# EasyEDA Pro project Access Control Core.eprj, board Card Reader
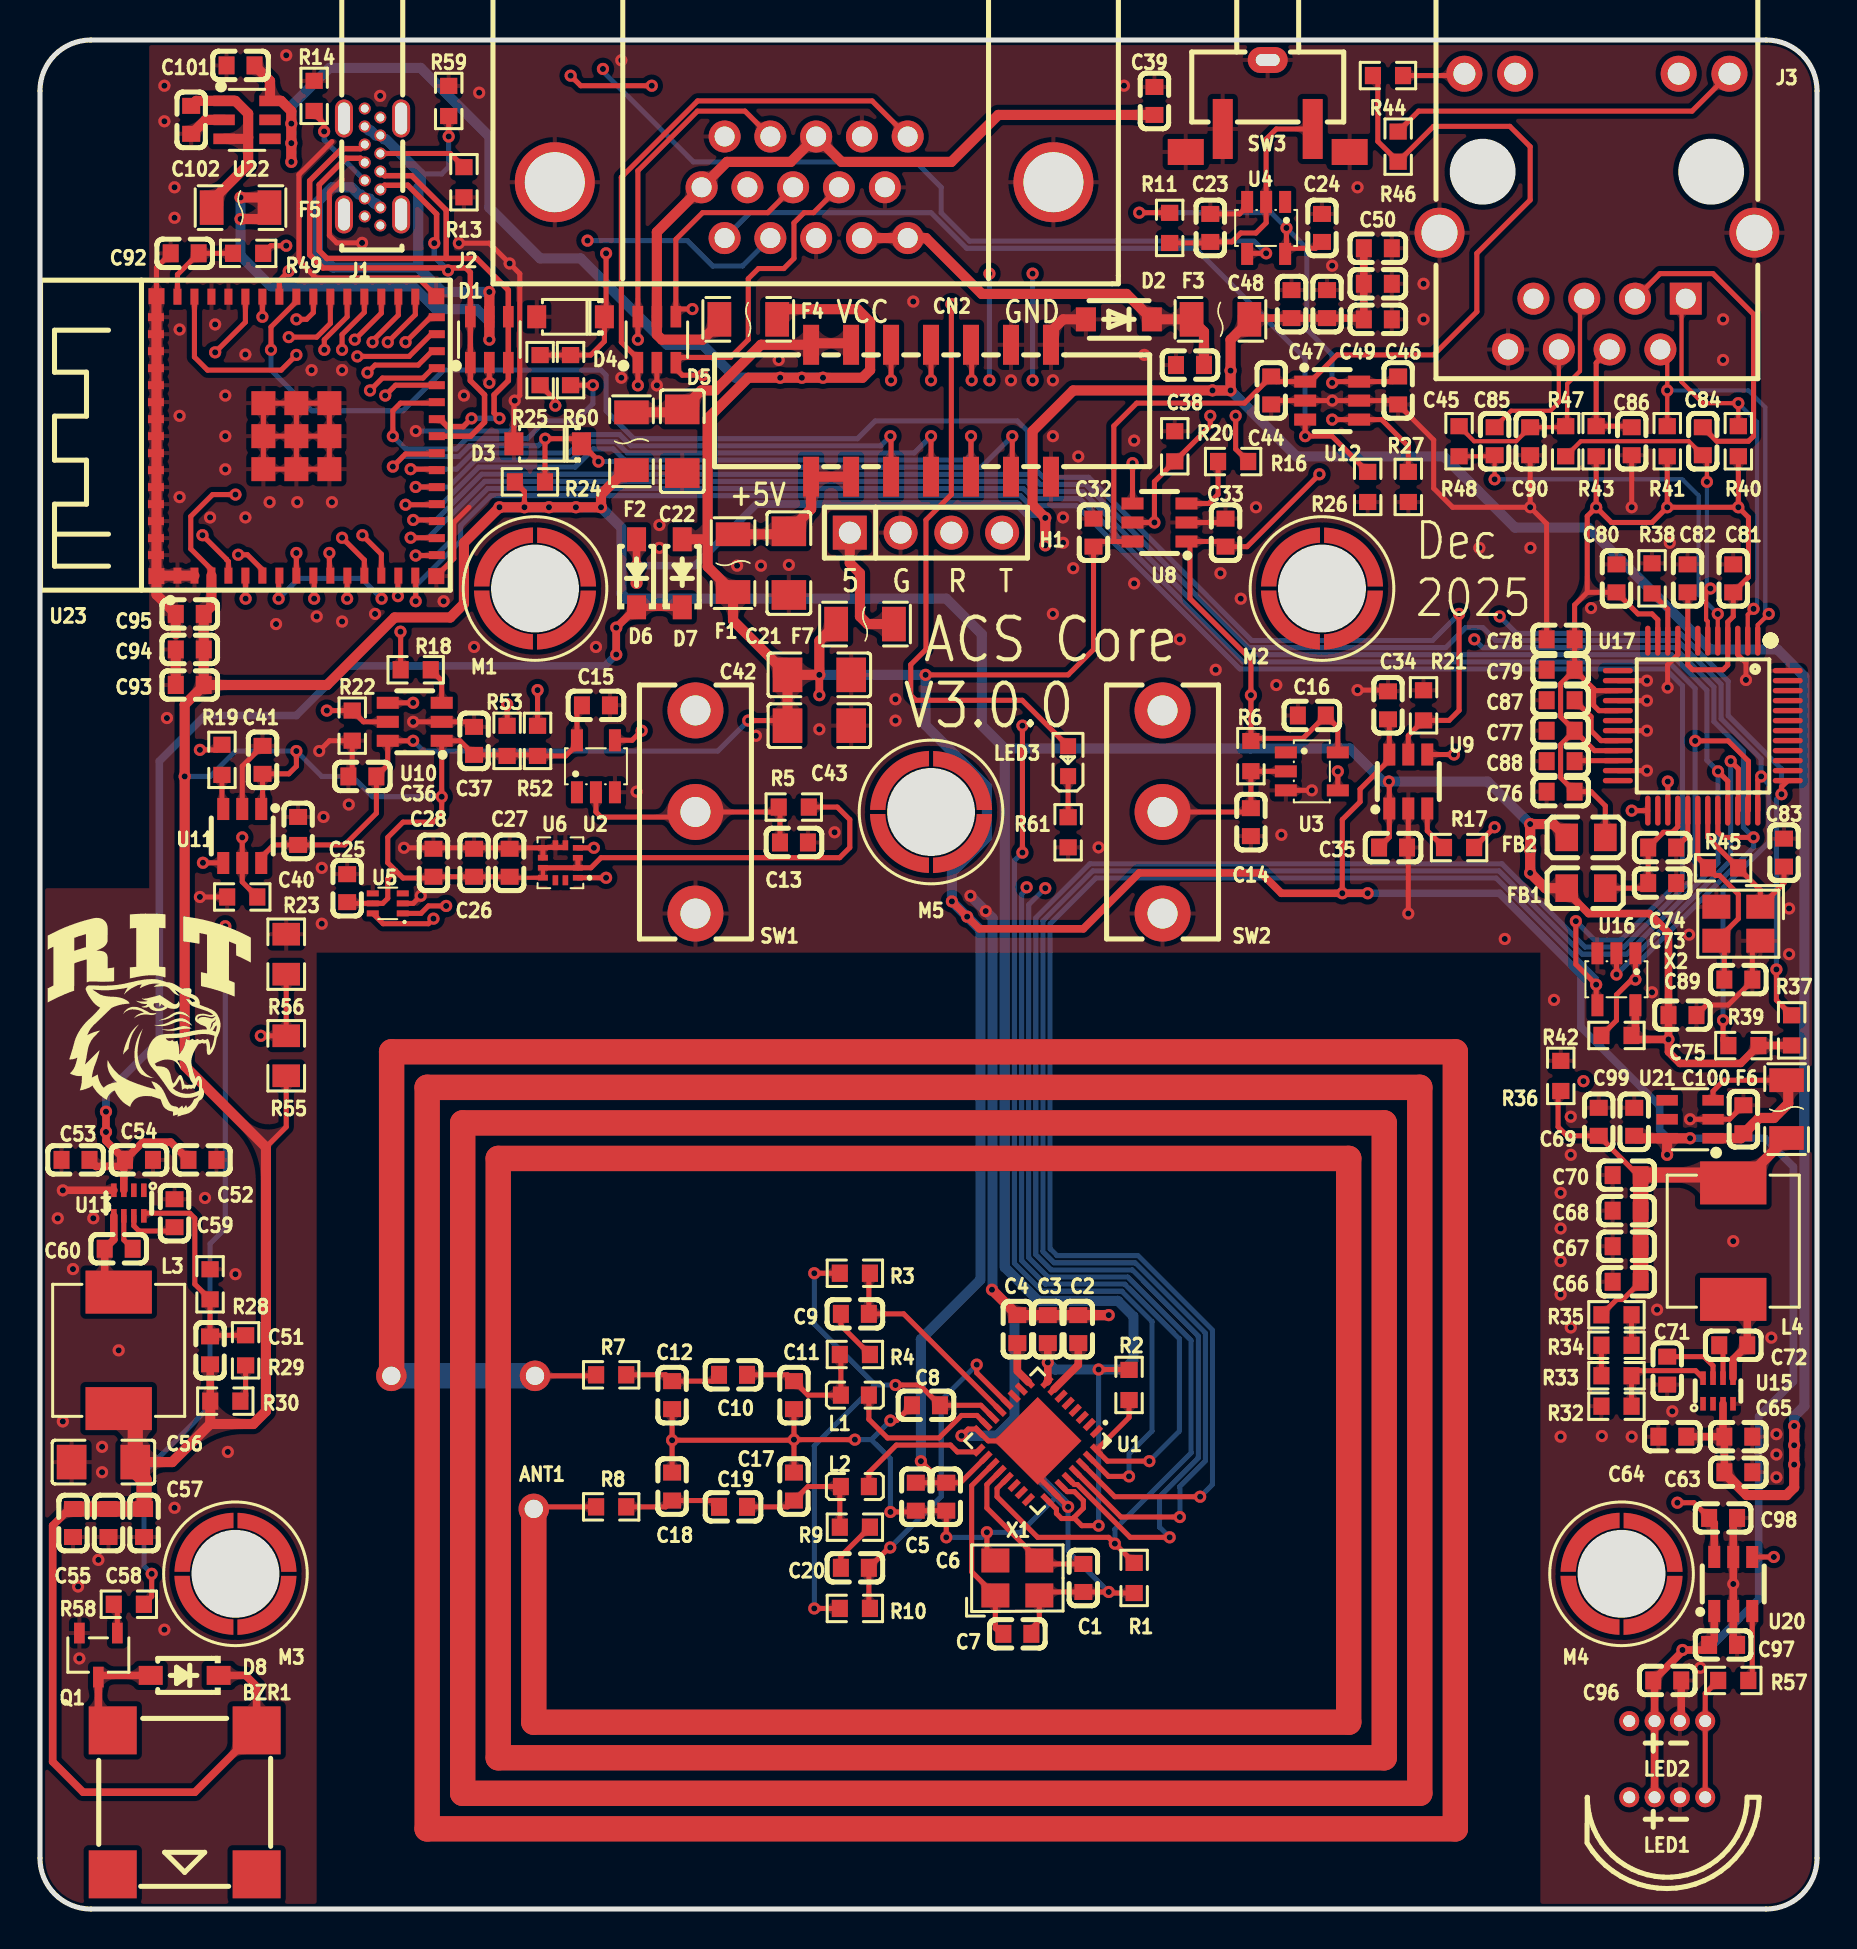
[diagram p11: board, top side]
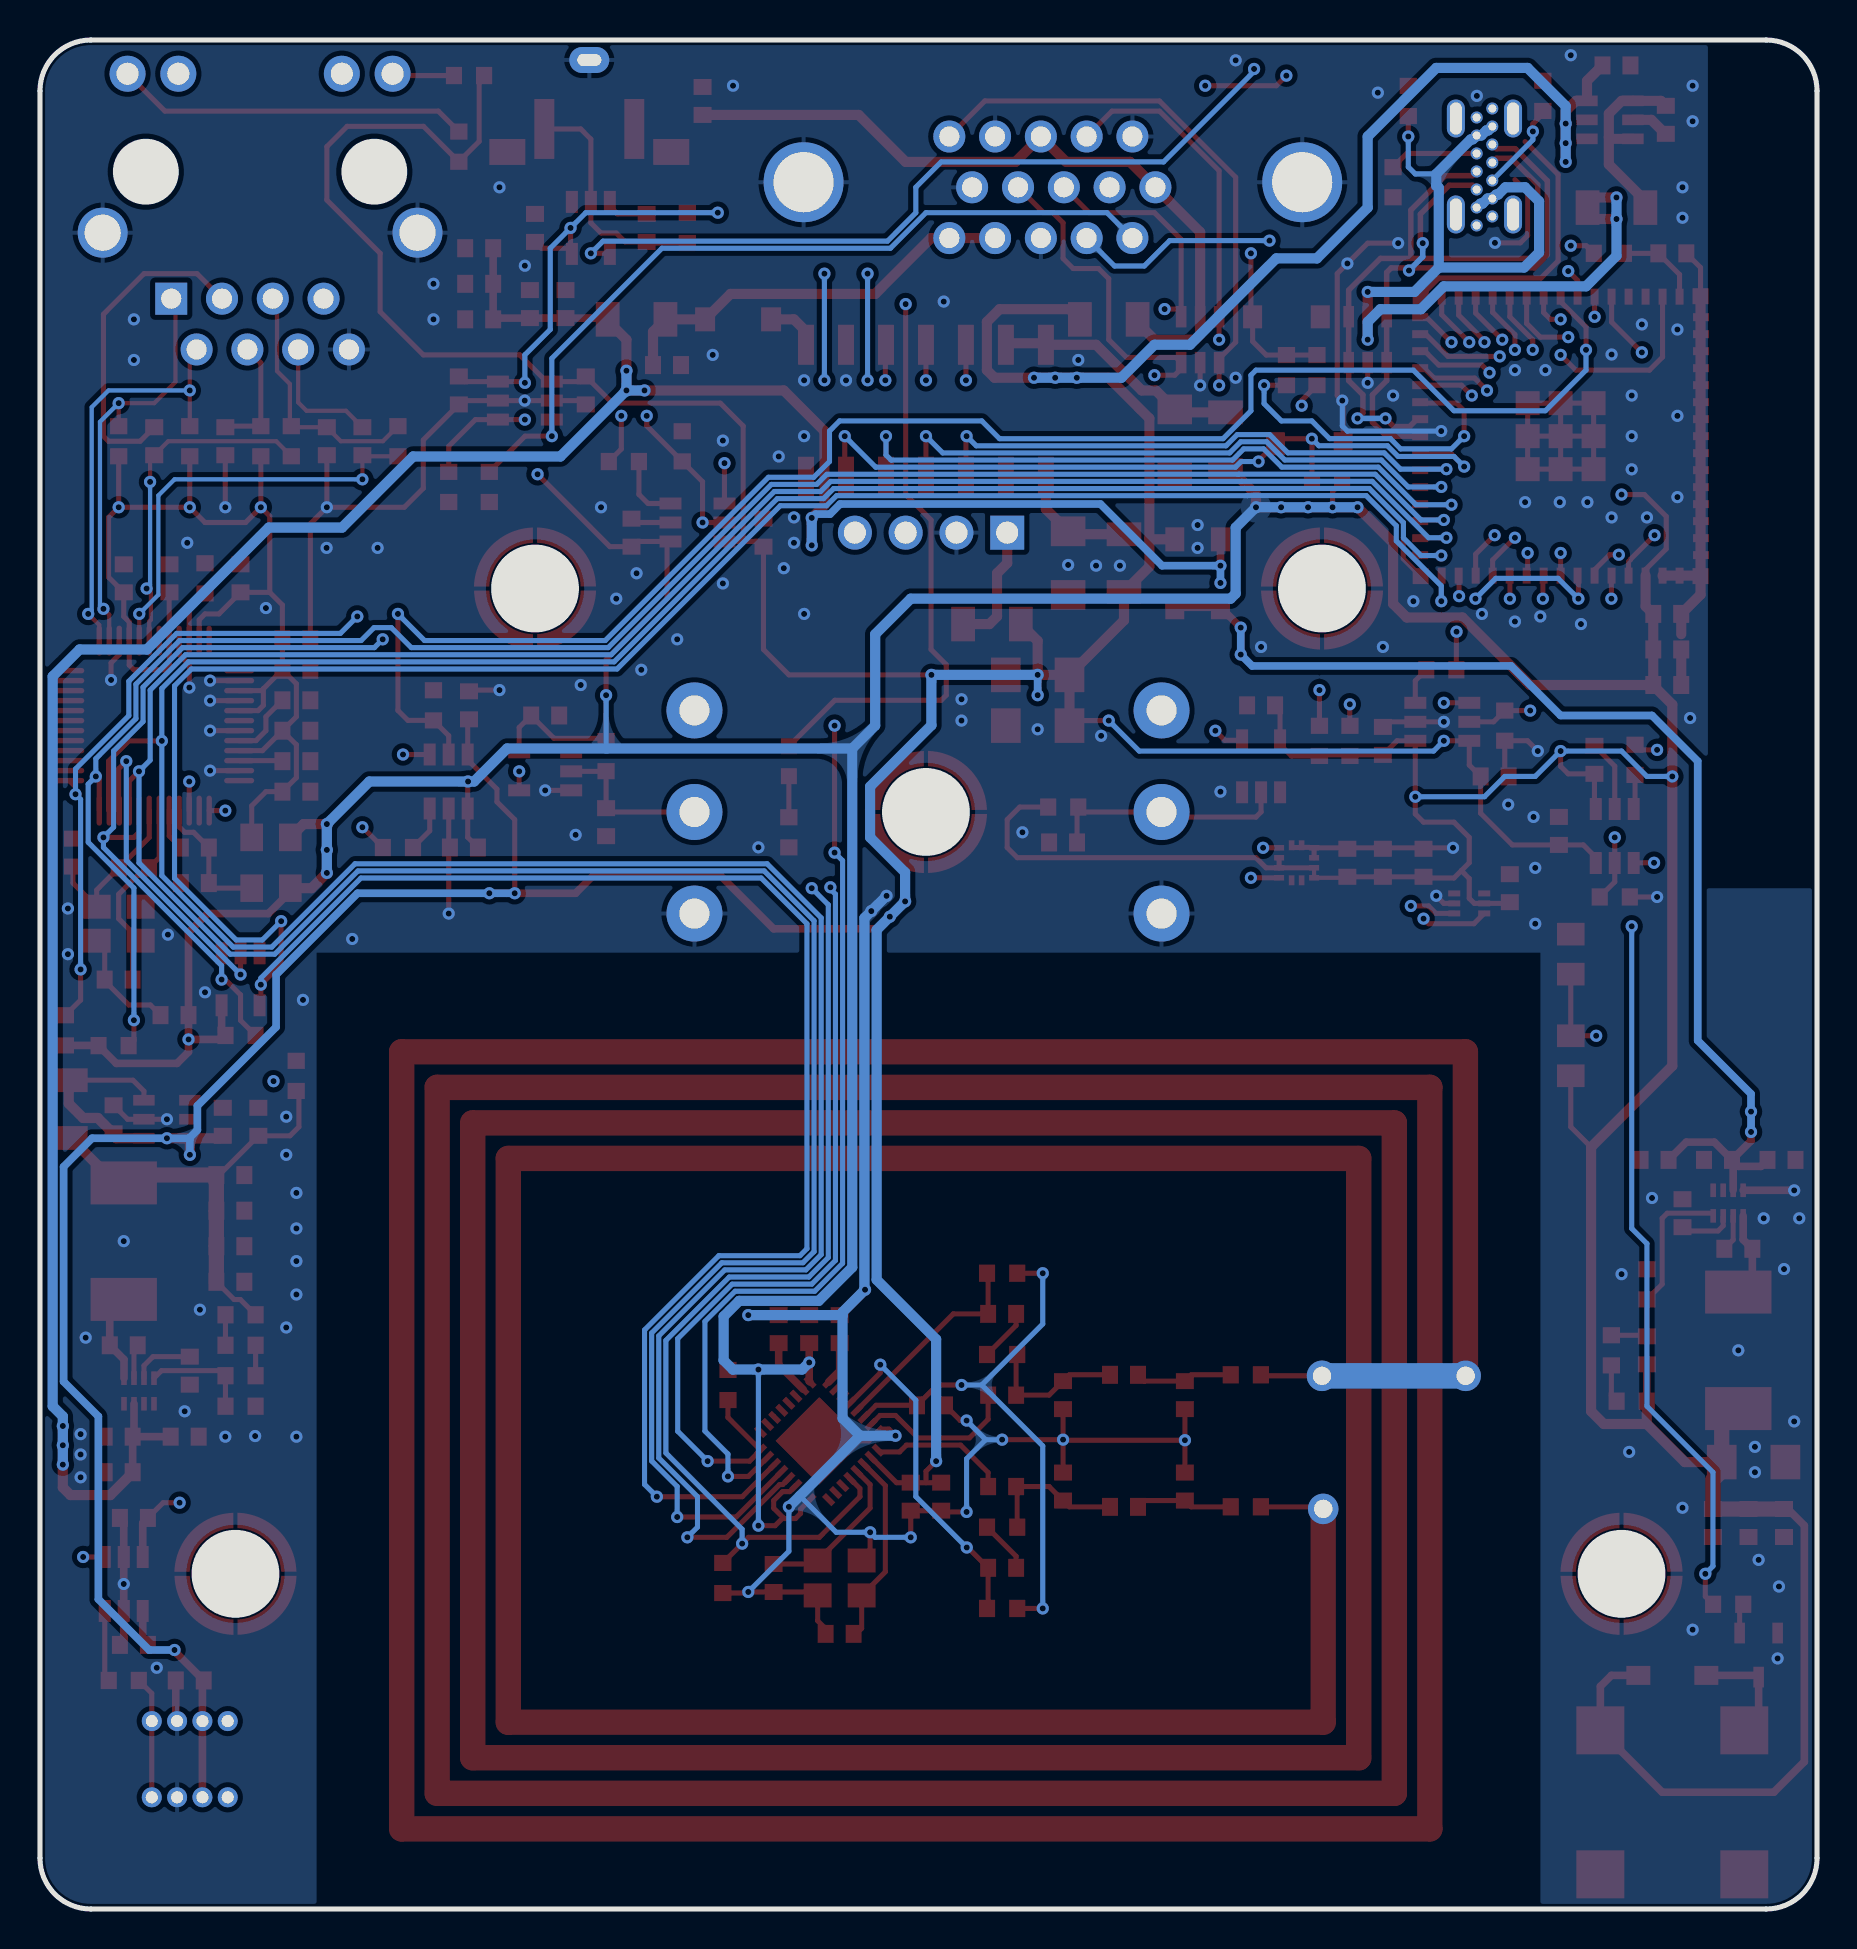
[diagram p12: board, bottom side, seen from below]

Outline 88.9 x 93.47 mm; copper layers: Top Layer, Inner1, Inner2, Bottom Layer. Coordinates in mm from the lower left corner of the outline.
Outline path: 0,90.93 0,2.54 arc(0.74,0.74) 2.54,0 86.36,0 arc(88.16,0.74) 88.9,2.54 88.9,90.93 arc(88.16,92.73) 86.36,93.47 2.54,93.47 arc(0.74,92.73) 0,90.93
Stack: Top Layer 0.035mm Outer layer thickness 1oz / Dielectric1 0.48mm 7628 RC49% 8.6mil / Inner1 0.035mm Inner layer thickness / Dielectric2 0.48mm 1.1mm H/HOZ Copper / Inner2 0.035mm Inner layer thickness / Dielectric3 0.48mm 7628 RC49% 8.6mil / Bottom Layer 0.035mm Outer layer thickness 1oz

## Design rules (mm)
net TXP: Eth TX
net TXN: Eth TX
net DP: USB
net DM: USB
net RXN: Eth RX
net RXP: Eth RX
template: Custom Config
spacing copperThickness1oz (default): track to track 0.102, other pairs 0.152 to 0.3
spacing copperThickness2oz: track to track 0.203, other pairs 0.152 to 0.3
track width copperThickness1oz (default): min 0.127, default 0.254, max 2.54
track width copperThickness2oz: min 0.203, default 0.254, max 2.54
differential pair differentialPair (default): width min 0.127, default 0.254, max 2.54; gap min 0.152, default 0.152
differential pair USB Coplanar: width min 0.274, default 0.274, max 0.274; gap min 0.203, default 0.203
differential pair Eth Coplanar: width min 0.211, default 0.211, max 0.211; gap min 0.203, default 0.203
via viaSize (default): diameter min 0.5, default 0.61, max 10; hole min 0.3, default 0.305, max 6.3
net TXP uses Eth Coplanar
net TXN uses Eth Coplanar
net DP uses USB Coplanar
net $7N2220 uses Eth Coplanar
net DM uses USB Coplanar
net RXN uses Eth Coplanar
net RXP uses Eth Coplanar
diff pair Eth TX uses Eth Coplanar
diff pair USB uses USB Coplanar
diff pair Eth RX uses Eth Coplanar

## Placement (name value [footprint] x y rotation side)
ANT1  -  [NFC Antenna Footprint]  43.31 23.16 270 top
BZR1  2.7kHz  [BUZ-SMD_4P-L8.5-W8.5-P8.50-TL]  7.24 5.33 270 top
C1  12pF  [C0603]  52.2 16.56 90 top
C2  470nF  [C0603]  51.94 29 90 top
C3  100nF  [C0603]  50.42 29 270 top
C4  470nF  [C0603]  48.89 29 270 top
C5  1uF  [C0603]  43.82 20.62 90 top
C6  100nF  [C0603]  45.34 20.62 90 top
C7  12pF  [C0603]  48.89 13.76 180 top
C8  100nF  [C0603]  44.32 25.19 0 top
C9  1nF  [C0603]  40.77 29.76 180 top
C10  68pF  [C0603]  34.67 26.72 180 top
C11  120pF  [C0603]  37.72 25.7 90 top
C12  120pF  [C0603]  31.62 25.7 90 top
C13  100nF  [C0603]  37.72 53.34 180 top
C14  100nF  [C0603]  60.58 54.36 90 top
C15  100nF  [C0603]  27.81 60.2 180 top
C16  100nF  [C0603]  63.63 59.69 0 top
C17  120pF  [C0603]  37.72 21.13 90 top
C18  120pF  [C0603]  31.62 21.13 90 top
C19  68pF  [C0603]  34.67 20.11 180 top
C20  1nF  [C0603]  40.77 17.06 180 top
C21  47uF  [C1206]  37.47 67.31 270 top
C22  47uF  [C1206]  32.13 73.41 90 top
C23  100nF  [C0603]  58.55 84.07 270 top
C24  100nF  [C0603]  64.14 84.07 270 top
C25  10nF  [C0603]  15.37 51.05 270 top
C26  100nF  [C0603]  21.72 52.32 270 top
C27  100nF  [C0603]  23.5 52.32 270 top
C28  10uF  [C0603]  19.69 52.32 270 top
C32  100nF  [C0603]  52.7 68.83 270 top
C33  100nF  [C0603]  59.31 68.83 270 top
C34  100nF  [C0603]  67.44 60.2 270 top
C35  100nF  [C0603]  67.69 53.09 180 top
C36  100nF  [C0603]  16.13 56.64 0 top
C37  100nF  [C0603]  21.72 58.42 270 top
C38  10uF  [C0603]  57.53 77.22 0 top
C39  10uF  [C0603]  55.75 90.42 270 top
C40  100nF  [C0603]  12.91 53.92 270 top
C41  100nF  [C0603]  11.14 57.47 270 top
C42  47uF  [C1206]  38.99 61.72 180 top
C43  47uF  [C1206]  38.99 59.18 180 top
C44  100nF  [C0603]  61.6 75.95 90 top
C45  100nF  [C0603]  67.95 75.95 90 top
C46  10uF  [C0603]  66.93 79.5 180 top
C47  10uF  [C0603]  64.39 80.26 270 top
C48  10uF  [C0603]  62.61 80.26 270 top
C49  10uF  [C0603]  66.93 81.28 180 top
C50  10uF  [C0603]  66.93 83.06 180 top
C51  30pF  [C0603]  8.51 27.94 270 top
C52  10uF  [C0603]  8.13 37.47 180 top
C53  10uF  [C0603]  1.78 37.47 0 top
C54  100nF  [C0603]  4.95 37.47 180 top
C55  10uF  [C0603]  1.65 19.3 90 top
C56  47uF  [C1206]  3.18 22.35 0 top
C57  10uF  [C0603]  5.21 19.3 90 top
C58  10uF  [C0603]  3.43 19.3 90 top
C59  33nF  [C0603]  6.73 34.8 90 top
C60  100nF  [C0603]  3.94 33.02 180 top
C63  10uF  [C0603]  84.96 21.84 180 top
C64  10uF  [C0603]  81.66 23.62 0 top
C65  100nF  [C0603]  84.96 23.62 180 top
C66  10uF  [C0603]  79.38 31.37 0 top
C67  10uF  [C0603]  79.38 33.15 0 top
C68  10uF  [C0603]  79.38 34.92 0 top
C69  10uF  [C0603]  77.98 39.37 270 top
C70  10uF  [C0603]  79.38 36.7 0 top
C71  33nF  [C0603]  81.41 26.92 270 top
C72  100nF  [C0603]  84.71 28.19 0 top
C73  10uF  [C0603]  81.15 51.31 180 top
C74  100nF  [C0603]  81.15 53.09 180 top
C75  100nF  [C0603]  82.17 44.7 0 top
C76  10uF  [C0603]  76.07 55.88 0 top
C77  100nF  [C0603]  76.07 58.93 0 top
C78  100nF  [C0603]  76.07 63.5 0 top
C79  100nF  [C0603]  76.07 61.98 0 top
C80  100nF  [C0603]  78.87 66.55 270 top
C81  100nF  [C0603]  84.71 66.55 270 top
C82  100nF  [C0603]  82.42 66.55 270 top
C83  18pF  [C0603]  87.25 52.83 90 top
C84  6.8nF  [C0603]  83.19 73.41 270 top
C85  6.8nF  [C0603]  72.77 73.41 270 top
C86  10nF  [C0603]  79.63 73.41 90 top
C87  4.7uF  [C0603]  76.07 60.45 0 top
C88  10nF  [C0603]  76.07 57.4 0 top
C89  18pF  [C0603]  84.96 46.48 0 top
C90  10nF  [C0603]  74.55 73.41 90 top
C92  1uF  [C0603]  7.24 82.8 0 top
C93  10uF  [C0603]  7.49 61.21 0 top
C94  10uF  [C0603]  7.49 62.99 0 top
C95  100nF  [C0603]  7.49 64.77 0 top
C96  100nF  [C0603]  81.41 11.43 180 top
C97  100nF  [C0603]  84.2 13.21 180 top
C98  100nF  [C0603]  84.2 19.56 180 top
C99  10uF  [C0603]  79.76 39.37 270 top
C100  1uF  [C0603]  85.22 39.5 270 top
C101  10uF  [C0603]  10.03 92.2 0 top
C102  1uF  [C0603]  7.56 89.48 90 top
CN2  B-3002N14P-0110  [IDC-SMD_14P-P2.00_B-3002N14P-0110]  44.58 74.93 0 top
D1  SRV05-4  [SOT-23-6_L2.9-W1.6-P0.95-LS2.8-BL]  22.48 78.49 0 top
D2  SMFJ12A  [SOD-123F_L2.8-W1.8-LS3.7-RD]  53.98 79.5 180 top
D3  PTVS3V3S1UR,115  [SOD-123_L2.8-W1.8-LS3.7-RD]  25.4 73.28 180 top
D4  PTVS3V3S1UR,115  [SOD-123_L2.8-W1.8-LS3.7-RD]  26.54 79.63 180 top
D5  SRV05-4  [SOT-23-6_L2.9-W1.6-P0.95-LS2.8-BL]  30.86 78.49 0 top
D6  B5819W SL  [SOD-123_L2.7-W1.6-LS3.7-RD-1]  29.85 66.8 90 top
D7  B5819W SL  [SOD-123_L2.7-W1.6-LS3.7-RD-1]  32.13 66.8 90 top
D8  B5819W SL  [SOD-123_L2.7-W1.6-LS3.7-RD-1]  7.24 11.68 180 top
F1  SMD1206B050TF  [F1206]  34.67 67.31 90 top
F2  SMD1206B050TF  [F1206]  29.59 73.41 270 top
F3  JK-nSMD100-16  [F1206]  59.05 79.5 180 top
F4  JK-nSMD100-16  [F1206]  35.43 79.5 180 top
F5  SMD1206B050TF  [F1206]  10.03 85.09 180 top
F6  JK-nSMD100-16  [F1206]  87.38 40 90 top
F7  SMD1206B050TF  [F1206]  41.27 64.26 0 top
FB1  MH2029-300Y  [L0805]  77.34 51.05 0 top
FB2  MH2029-300Y  [L0805]  77.34 53.59 0 top
H1  -  [HDR-TH_4P-P2.54-V-M]  44.32 68.83 0 top
J1  HC-GAP-ACF012-1T  [USB-C-SMD_HC-GAP-ACF012-1T-1]  16.64 87.12 180 top
J2  DS1038-15FBNSiA74-0CC  [DSUB-TH_DS1038-15FBNSIA74-0CC]  38.23 86.11 180 top
J3  HC913129AE-907-A  [RJ45-TH_HC911102A-904-A]  77.89 84.89 180 top
L1  470nH  [L0603]  40.77 25.7 180 top
L2  470nH  [L0603]  40.77 21.13 180 top
L3  4.7uH  [IND-SMD_L7.1-W6.6]  3.94 27.94 270 top
L4  4.7uH  [IND-SMD_L7.1-W6.6]  84.71 33.4 90 top
LED1  WS2812D-F8  [LED-TH_WS2812D-F8]  81.41 5.59 0 top
LED2  WS2812D-F8  [LED-TH_WS2812D-F8]  81.41 9.4 0 top
LED3  KT-0603R  [LED0603-RD]  51.44 57.4 90 top
M1  SMTSO3060CTJ  [SMD_SMTSO3060CTJ]  24.77 66.04 0 top
M2  SMTSO3060CTJ  [SMD_SMTSO3060CTJ]  64.14 66.04 0 top
M3  SMTSO3060CTJ  [SMD_SMTSO3060CTJ]  9.78 16.76 0 top
M4  SMTSO3060CTJ  [SMD_SMTSO3060CTJ]  79.12 16.76 0 top
M5  SMTSO3060CTJ  [SMD_SMTSO3060CTJ]  44.58 54.86 0 top
Q1  S8050 J3Y  [SOT-23-3_L3.0-W1.7-P0.95-LS2.9-BR]  2.92 12.7 90 top
R1  10kΩ  [R0603]  54.74 16.56 90 top
R2  10kΩ  [R0603]  54.48 26.21 90 top
R3  1kΩ  [R0603]  40.77 31.8 180 top
R4  22kΩ  [R0603]  40.77 27.73 180 top
R5  100kΩ  [R0603]  37.71 55.11 180 top
R6  100kΩ  [R0603]  60.58 57.66 270 top
R7  5.1Ω  [R0603]  28.58 26.72 180 top
R8  5.1Ω  [R0603]  28.58 20.11 180 top
R9  22kΩ  [R0603]  40.77 19.1 180 top
R10  1kΩ  [R0603]  40.77 15.03 180 top
R11  100kΩ  [R0603]  56.52 84.07 270 top
R13  5.1kΩ  [R0603]  21.21 86.36 90 top
R14  5.1kΩ  [R0603]  13.72 90.68 270 top
R16  4.7kΩ  [R0603]  59.69 72.39 0 top
R17  4.7kΩ  [R0603]  70.99 53.09 0 top
R18  4.7kΩ  [R0603]  18.8 61.98 180 top
R19  4.7kΩ  [R0603]  9.1 57.47 90 top
R20  10kΩ  [R0603]  56.77 73.15 90 top
R21  10kΩ  [R0603]  69.22 60.2 90 top
R22  10kΩ  [R0603]  15.62 59.18 270 top
R23  10kΩ  [R0603]  10.12 50.61 180 top
R24  4.7kΩ  [R0603]  24.51 71.37 180 top
R25  4.7kΩ  [R0603]  25.02 76.96 270 top
R26  10kΩ  [R0603]  66.42 71.12 270 top
R27  10kΩ  [R0603]  68.45 71.12 270 top
R28  10kΩ  [R0603]  8.51 31.24 90 top
R29  10kΩ  [R0603]  10.29 27.94 90 top
R30  22kΩ  [R0603]  9.27 25.4 0 top
R32  10kΩ  [R0603]  78.87 25.15 180 top
R33  1kΩ  [R0603]  78.87 26.67 180 top
R34  1kΩ  [R0603]  78.87 28.19 0 top
R35  51kΩ  [R0603]  78.87 29.72 180 top
R36  1kΩ  [R0603]  76.08 41.66 270 top
R37  10kΩ  [R0603]  87.63 43.94 90 top
R38  12.4kΩ  [R0603]  80.64 66.55 270 top
R39  10kΩ  [R0603]  85.22 43.18 180 top
R40  49.9Ω  [R0603]  84.96 73.41 270 top
R41  49.9Ω  [R0603]  81.41 73.41 270 top
R42  10kΩ  [R0603]  78.87 43.69 180 top
R43  10Ω  [R0603]  77.85 73.41 270 top
R44  1kΩ  [R0603]  67.44 91.69 180 top
R45  1MΩ  [R0603]  84.2 52.07 0 top
R46  1kΩ  [R0603]  67.95 88.14 270 top
R47  49.9Ω  [R0603]  76.33 73.41 270 top
R48  49.9Ω  [R0603]  70.99 73.41 270 top
R49  10kΩ  [R0603]  10.41 82.8 0 top
R52  4.7kΩ  [R0603]  24.89 58.42 90 top
R53  4.7kΩ  [R0603]  23.37 58.42 90 top
R55  0Ω  [R0805]  12.32 42.67 270 top
R56  0Ω  [R0805]  12.32 47.75 270 top
R57  75Ω  [R0603]  84.71 11.43 0 top
R58  1kΩ  [R0603]  4.45 15.24 180 top
R59  1kΩ  [R0603]  20.45 90.42 270 top
R60  10kΩ  [R0603]  26.54 76.96 270 top
R61  1kΩ  [R0603]  51.44 53.85 90 top
SW1  K9-1267F  [SW-TH_K9-1267F]  32.79 54.86 90 top
SW2  K9-1267F  [SW-TH_K9-1267F]  56.16 54.86 90 top
SW3  TS-1045-A13B3-D2  [SW-SMD_L7.5-W8.0-P4.50_TS-1045-A13B3-D2]  61.42 90.17 180 top
U1  MFRC63003HNE  [HVQFN-32_L5.0-W5.0-P0.50-TL-EP3.1]  49.91 23.41 225 top
U2  SN74LVC1G17DBVR  [SOT-23-5_L3.0-W1.7-P0.95-LS2.8-BR]  27.81 57.15 270 top
U3  SN74LVC1G17DBVR  [SOT-23-5_L3.0-W1.7-P0.95-LS2.8-BR]  63.63 56.9 180 top
U4  SN74LVC1G17DBVR  [SOT-23-5_L3.0-W1.7-P0.95-LS2.8-BR]  61.34 84.07 90 top
U5  TMP112AIDRLR  [SOT-563_L1.6-W1.2-P0.50-LS1.6-BR]  17.4 50.29 0 top
U6  LIS2DH12TR  [LGA-12_L2.0-W2.0-P0.50-BL]  26.04 52.32 90 top
U8  SN74LVC1T45DBVR  [SOT-23-6_L2.9-W1.6-P0.95-LS2.8-BR]  56.01 69.34 0 top
U9  SN74LVC1T45DBVR  [SOT-23-6_L2.9-W1.6-P0.95-LS2.8-BR]  68.45 56.39 270 top
U10  SN74LVC1T45DBVR  [SOT-23-6_L2.9-W1.6-P0.95-LS2.8-BR]  18.75 59.37 0 top
U11  SN74LVC1T45DBVR  [SOT-23-6_L2.9-W1.6-P0.95-LS2.8-BR]  10.12 53.66 90 top
U12  SN74LVC1T45DBVR  [SOT-23-6_L2.9-W1.6-P0.95-LS2.8-BR]  64.64 75.44 180 top
U13  TPS62933DRLR  [SOT-583-8_L2.1-W1.2-P0.50-LS1.6-BR]  4.45 35.31 90 top
U15  TPS62933DRLR  [SOT-583-8_L2.1-W1.2-P0.50-LS1.6-BR]  83.95 25.91 270 top
U16  SN74AHC1G125DBVR  [SOT-23-5_L3.0-W1.7-P0.95-LS2.8-BR]  78.86 46.5 90 top
U17  W5500  [LQFP-48_L7.0-W7.0-P0.50-LS9.0-BL]  83.19 59.18 180 top
U20  SN74LVC1T45DBVR  [SOT-23-6_L2.9-W1.6-P0.95-LS2.8-BR]  84.71 16.26 270 top
U21  MX66100T  [SOT-23-6_L2.9-W1.6-P0.95-LS2.9-BL]  82.55 39.5 90 top
U22  MX66100T  [SOT-23-6_L2.9-W1.6-P0.95-LS2.9-BL]  10.36 89.48 270 top
U23  2.4GHz  [BULETM-SMD_ESP32-S3-MINI-1-N8]  12.83 73.66 90 top
X1  27.12MHz  [CRYSTAL-SMD_4P-L3.2-W2.5-BL-1]  48.89 16.56 0 top
X2  25MHz  [CRYSTAL-SMD_4P-L3.2-W2.5-BL]  84.96 49.28 180 top

## Footprints (pads in the part's own frame, mm; a bottom-side part is the same pattern mirrored in y, then rotated)
BULETM-SMD_ESP32-S3-MINI-1-N8
  rect 0.8x0.4 smd: 1(-6.975,5.95) 2(-6.975,5.1) 3(-6.975,4.25) 4(-6.975,3.4) 5(-6.975,2.55) 6(-6.975,1.7) 7(-6.975,0.85) 8(-6.975,0) 9(-6.975,-0.85) 10(-6.975,-1.7) 11(-6.975,-2.55) 12(-6.975,-3.4) 13(-6.975,-4.25) 14(-6.975,-5.1) 15(-6.975,-5.95) 31(6.975,-5.95) 32(6.975,-5.1) 33(6.975,-4.25) 34(6.975,-3.4) 35(6.975,-2.55) 36(6.975,-1.7) 37(6.975,-0.85) 38(6.975,0) 39(6.975,0.85) 40(6.975,1.7) 41(6.975,2.55) 42(6.975,3.4) 43(6.975,4.25) 44(6.975,5.1) 45(6.975,5.95)
  rect 0.4x0.8 smd: 16(-5.95,-7.025) 17(-5.1,-7.025) 18(-4.25,-7.025) 19(-3.4,-7.025) 20(-2.55,-7.025) 21(-1.7,-7.025) 22(-0.85,-7.025) 23(0,-7.025) 24(0.85,-7.025) 25(1.7,-7.025) 26(2.55,-7.025) 27(3.4,-7.025) 28(4.25,-7.025) 29(5.1,-7.025) 30(5.95,-7.025) 46(5.95,7.025) 47(5.1,7.025) 48(4.25,7.025) 49(3.4,7.025) 50(2.55,7.025) 51(1.7,7.025) 52(0.85,7.025) 53(0,7.025) 54(-0.85,7.025) 55(-1.7,7.025) 56(-2.55,7.025) 57(-3.4,7.025) 58(-4.25,7.025) 59(-5.1,7.025) 60(-5.95,7.025)
  rect 0.8x0.8 smd: GND(-7,7) GND(-7,-7) GND(7,7) GND(7,-7)
  rect 1.2x1.2 smd: GND(-1.65,1.65) GND(-1.65,0) GND(-1.65,-1.65) GND(0,1.65) GND(0,0) GND(0,-1.65) GND(1.65,1.65) GND(1.65,0) GND(1.65,-1.65)
BUZ-SMD_4P-L8.5-W8.5-P8.50-TL
  rect 2.4x2.4 smd: 1(-3.6,3.6) 2(-3.6,-3.6) 3(3.599,-3.599) 4(3.6,3.6)
C0603
  rect 0.8x0.9 smd: 1(-0.7,0) 2(0.7,0)
C1206
  rect 1.485x1.728 smd: 1(-1.593,0) 2(1.593,0)
CRYSTAL-SMD_4P-L3.2-W2.5-BL
  rect 1.4x1.2 smd: 1(-1.1,-0.85) 2(1.1,-0.85) 3(1.1,0.85) 4(-1.1,0.85)
CRYSTAL-SMD_4P-L3.2-W2.5-BL-1
  rect 1.4x1.2 smd: 1(-1.1,-0.875) 2(1.1,-0.875) 3(1.1,0.875) 4(-1.1,0.875)
DSUB-TH_DS1038-15FBNSIA74-0CC
  round 1.6 hole 1: 1(3.978,2.54) 2(1.688,2.54) 3(-0.603,2.54) 4(-2.893,2.54) 5(-5.182,2.54) 6(5.128,0) 7(2.837,0) 8(0.548,0) 9(-1.743,0) 10(-4.042,0) 11(3.978,-2.54) 12(1.688,-2.54) 13(-0.603,-2.54) 14(-2.893,-2.54) 15(-5.182,-2.54)
  round 4 hole 3: 16(12.473,-0.254) 17(-12.473,-0.254)
F1206
  rect 1.19x1.728 smd: 1(-1.445,0) 2(1.445,0)
HDR-TH_4P-P2.54-V-M
  rect 1.7x1.7 hole 1.1: 1(-3.81,0)
  round 1.7 hole 1.1: 2(-1.27,0) 3(1.27,0) 4(3.81,0)
HVQFN-32_L5.0-W5.0-P0.50-TL-EP3.1
  rect 0.665x0.28 smd: 1(-2.408,1.75) 2(-2.408,1.25) 3(-2.408,0.75) 4(-2.408,0.25) 5(-2.408,-0.25) 6(-2.408,-0.75) 7(-2.408,-1.25) 8(-2.408,-1.75) 17(2.408,-1.75) 18(2.408,-1.25) 19(2.408,-0.75) 20(2.408,-0.25) 21(2.408,0.25) 22(2.408,0.75) 23(2.408,1.25) 24(2.408,1.75)
  rect 0.28x0.665 smd: 9(-1.75,-2.408) 10(-1.25,-2.408) 11(-0.75,-2.408) 12(-0.25,-2.408) 13(0.25,-2.408) 14(0.75,-2.408) 15(1.25,-2.408) 16(1.75,-2.408) 25(1.75,2.408) 26(1.25,2.408) 27(0.75,2.408) 28(0.25,2.408) 29(-0.25,2.408) 30(-0.75,2.408) 31(-1.25,2.408) 32(-1.75,2.408)
  rect 3.1x3.1 smd: 33(0,0)
IDC-SMD_14P-P2.00_B-3002N14P-0110
  rect 0.8x2 smd: 1(-6,-3.3) 2(-6,3.3) 3(-4,-3.3) 4(-4,3.3) 5(-2,-3.3) 6(-2,3.3) 7(0,-3.3) 8(0,3.3) 9(2,-3.3) 10(2,3.3) 11(4,-3.3) 12(4,3.3) 13(6,-3.3) 14(6,3.3)
IND-SMD_L7.1-W6.6
  rect 2.15x3.32 smd: 1(-2.913,0) 2(2.913,0)
L0603
  rect 0.8x0.864 smd: 1(-0.7,0) 2(0.7,0)
L0805
  rect 1.133x1.377 smd: 1(-0.966,0) 2(0.966,0)
LED0603-RD
  rect 0.8x0.8 smd: 1(-0.749,0) 2(0.749,0)
LED-TH_WS2812D-F8
  round 1 hole 0.6: 1(-1.9,0) 2(-0.633,0) 3(0.633,0) 4(1.9,0)
LGA-12_L2.0-W2.0-P0.50-BL
  rect 0.28x0.5 smd: 1(-0.75,-0.875) 2(-0.25,-0.875) 3(0.25,-0.875) 4(0.75,-0.875) 7(0.75,0.875) 8(0.25,0.875) 9(-0.25,0.875) 10(-0.75,0.875)
  rect 0.5x0.28 smd: 5(0.875,-0.25) 6(0.875,0.25) 11(-0.875,0.25) 12(-0.875,-0.25)
LQFP-48_L7.0-W7.0-P0.50-LS9.0-BL
  oval 0.27x1.5 smd: 1(-2.75,-4.25) 2(-2.25,-4.25) 3(-1.75,-4.25) 4(-1.25,-4.25) 5(-0.75,-4.25) 6(-0.25,-4.25) 7(0.25,-4.25) 8(0.75,-4.25) 9(1.25,-4.25) 10(1.75,-4.25) 11(2.25,-4.25) 12(2.75,-4.25) 25(2.75,4.25) 26(2.25,4.25) 27(1.75,4.25) 28(1.25,4.25) 29(0.75,4.25) 30(0.25,4.25) 31(-0.25,4.25) 32(-0.75,4.25) 33(-1.25,4.25) 34(-1.75,4.25) 35(-2.25,4.25) 36(-2.75,4.25)
  oval 1.5x0.27 smd: 13(4.25,-2.75) 14(4.25,-2.25) 15(4.25,-1.75) 16(4.25,-1.25) 17(4.25,-0.75) 18(4.25,-0.25) 19(4.25,0.25) 20(4.25,0.75) 21(4.25,1.25) 22(4.25,1.75) 23(4.25,2.25) 24(4.25,2.75) 37(-4.25,2.75) 38(-4.25,2.25) 39(-4.25,1.75) 40(-4.25,1.25) 41(-4.25,0.75) 42(-4.25,0.25) 43(-4.25,-0.25) 44(-4.25,-0.75) 45(-4.25,-1.25) 46(-4.25,-1.75) 47(-4.25,-2.25) 48(-4.25,-2.75)